# EasyEDA Pro project BLDCv5.eprj, schematic Schematic2_2
Board Name: SPDV4_THT_2; Create Date: 2025-03-22; Page Name: P1; Project Name: BLDCv5; Schematic Name: Schematic2_2; Update Date: 2025-03-22; Company: EasyEDA.com; Drawn: EasyEDA; Page Size: A4; Part Number: JLCPCB-002; Reviewed: EasyEDA; Version: V0.1
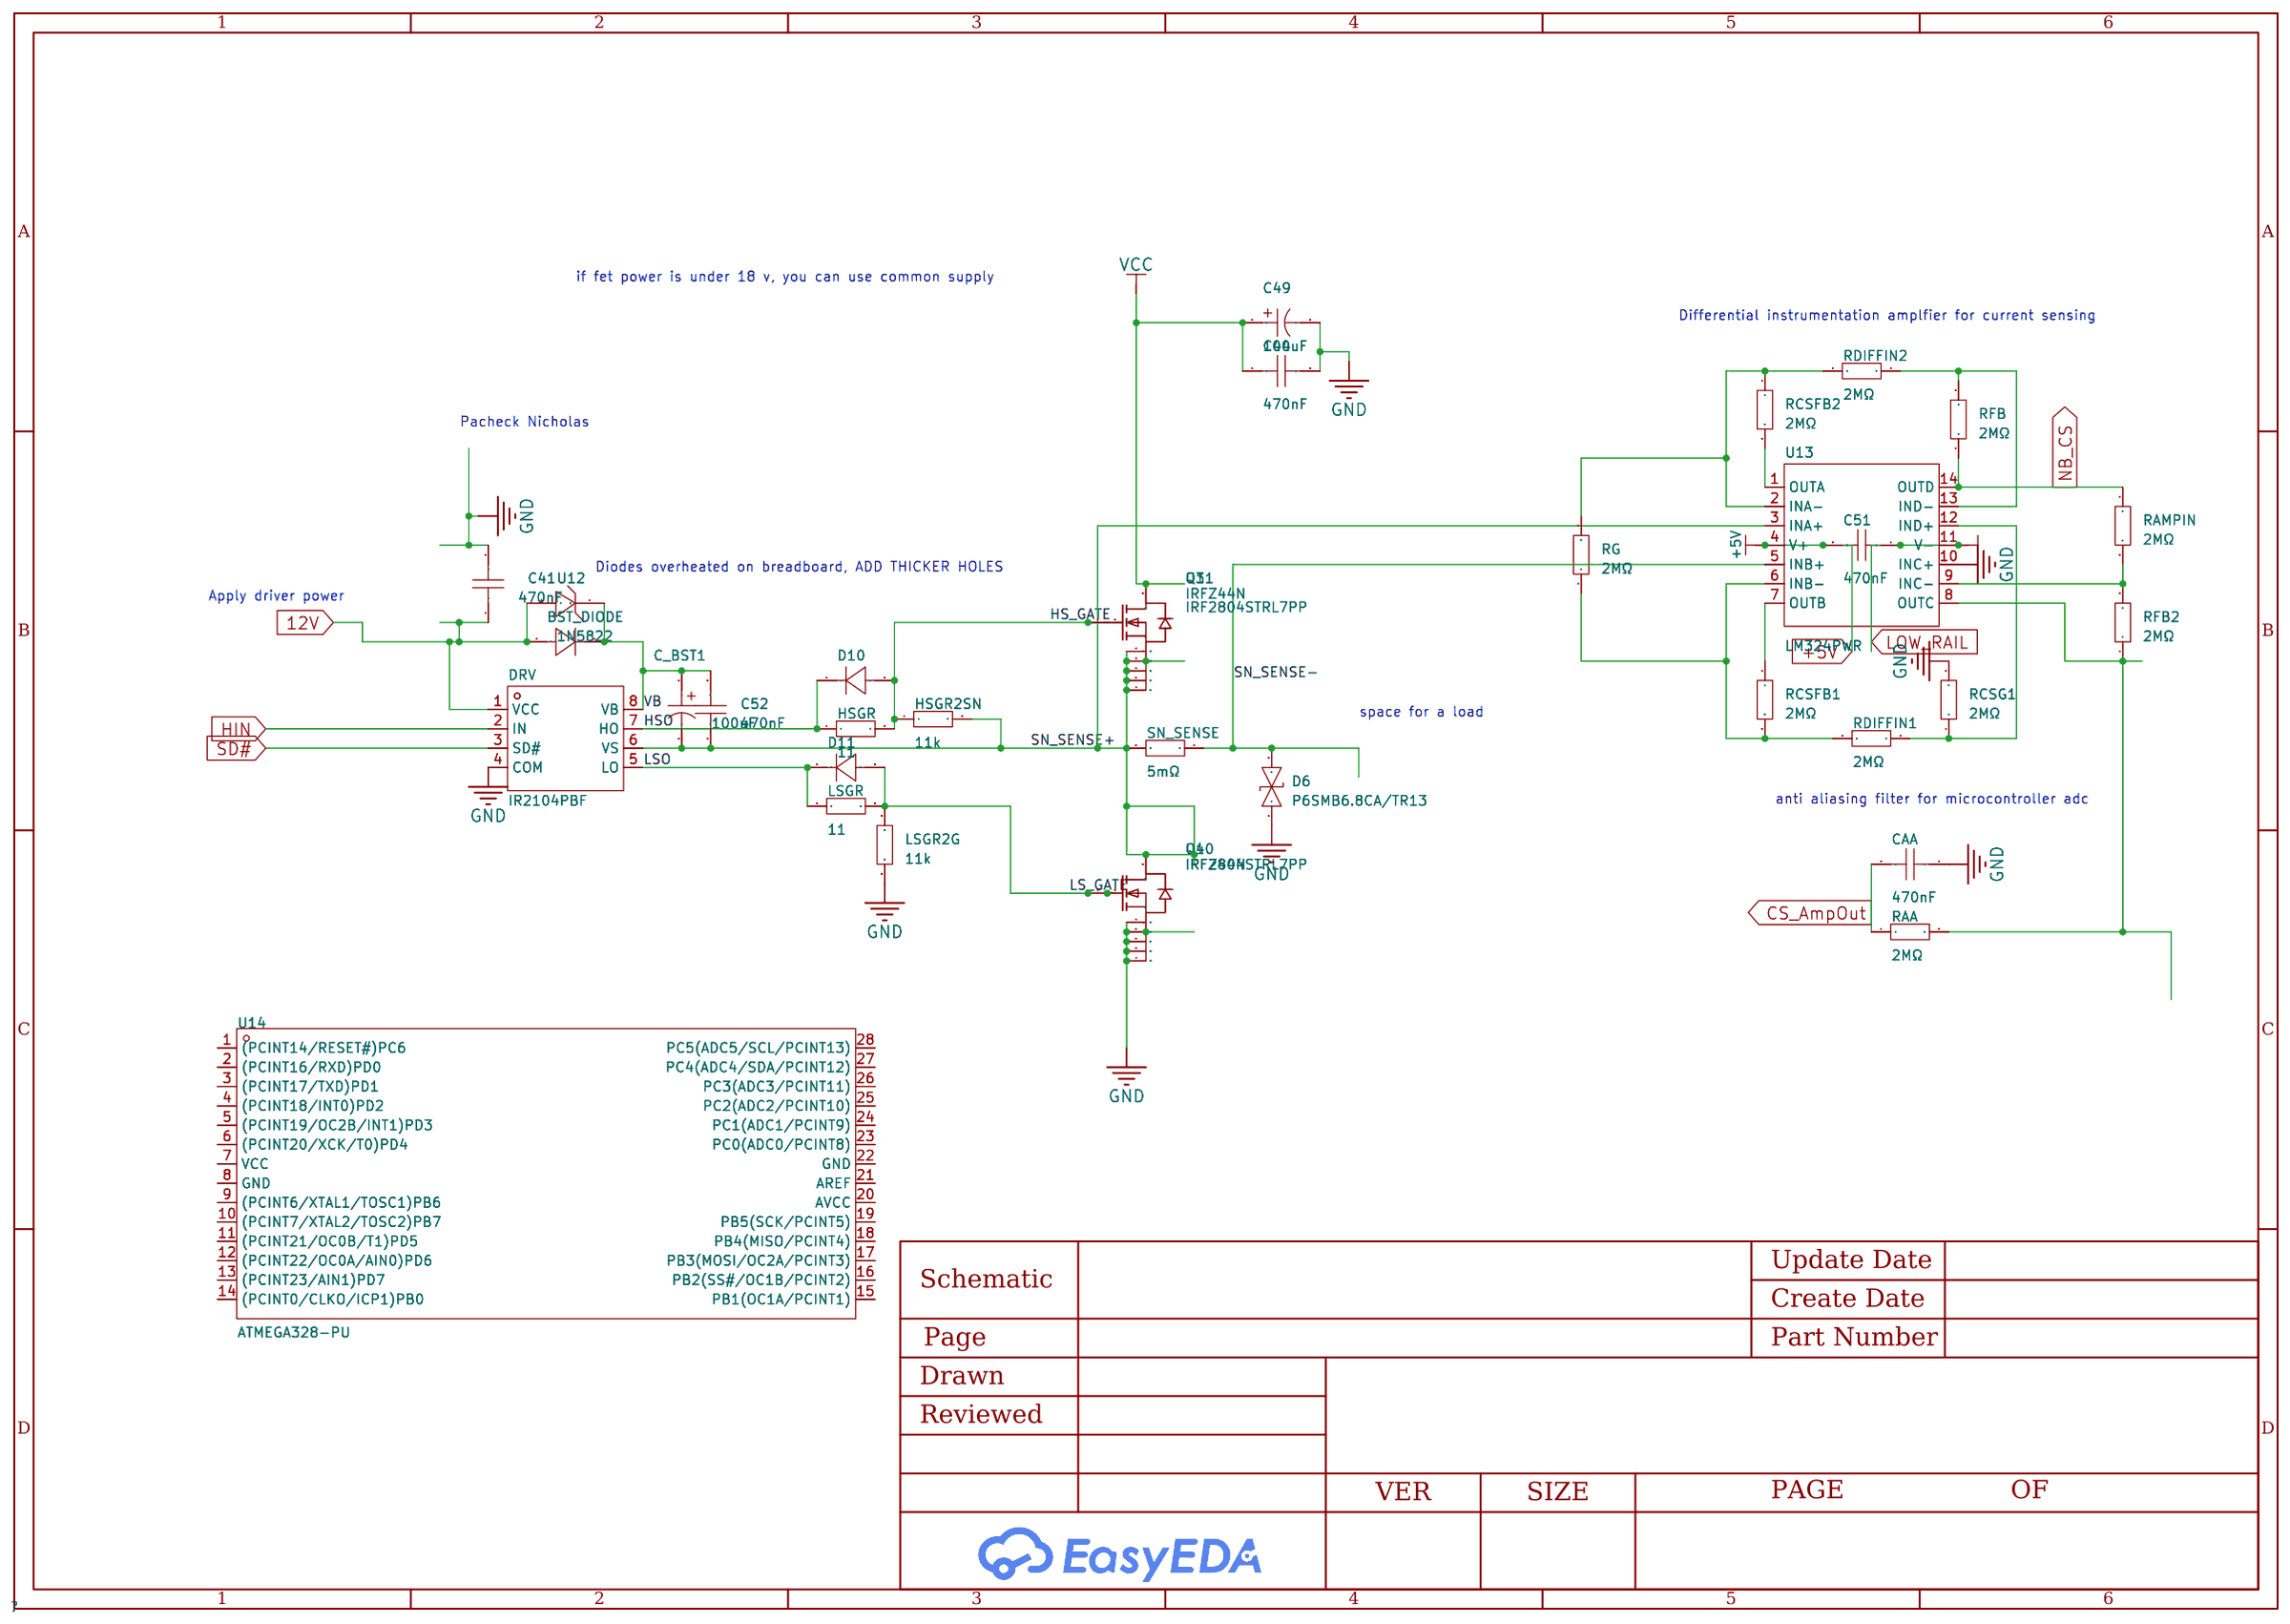
[diagram p5: schematic sheet]

## Parts
BST_DIODE  -  [DO-41_BD2.4-L4.7-P8.70-D0.9-RD]
C41  470nF  [CAP-TH_L7.2-W2.5-P5.00-D0.5]
C44  470nF  [CAP-TH_L7.2-W2.5-P5.00-D0.5]
C49  100uF  [CAP-TH_BD8.0-P3.50-D0.6-FD]
C51  470nF  [CAP-TH_L7.2-W2.5-P5.00-D0.5]
C52  470nF  [CAP-TH_L7.2-W2.5-P5.00-D0.5]
C_BST1  100uF  [CAP-TH_BD8.0-P3.50-D0.6-FD]
CAA  470nF  [CAP-TH_L7.2-W2.5-P5.00-D0.5]
D6  P6SMB6.8CA/TR13  [SMB_L4.6-W3.6-LS5.3-BI]
D10  -  [DO-41_BD2.4-L4.7-P8.70-D0.9-RD]
D11  -  [DO-41_BD2.4-L4.7-P8.70-D0.9-RD]
DRV  IR2104PBF  [DIP-8_L9.9-W6.6-P2.54-LS7.62-BL]
HSGR  11  [RES-TH_BD3.3-L9.0-P13.00-D0.6]
HSGR2SN  11k  [RES-TH_BD3.3-L9.0-P13.00-D0.6]
LSGR  11  [RES-TH_BD3.3-L9.0-P13.00-D0.6]
LSGR2G  11k  [RES-TH_BD3.3-L9.0-P13.00-D0.6]
Q3  IRF2804STRL7PP  [D2PAK-7_L10.6-W9.6-P1.27-LS15.9-BR]
Q4  IRF2804STRL7PP  [D2PAK-7_L10.6-W9.6-P1.27-LS15.9-BR]
RAA  2MΩ  [R0805]
RAMPIN  2MΩ  [R0805]
RCSFB1  2MΩ  [R0805]
RCSFB2  2MΩ  [R0805]
RCSG1  2MΩ  [R0805]
RDIFFIN1  2MΩ  [R0805]
RDIFFIN2  2MΩ  [R0805]
RFB  2MΩ  [R0805]
RFB2  2MΩ  [R0805]
RG  2MΩ  [R0805]
SN_SENSE  5mΩ  [R2512]
U10  IRFZ44N  [TO-220-3_L9.9-W4.5-P2.54-L]
U11  IRFZ44N  [TO-220-3_L9.9-W4.5-P2.54-L]
U12  1N5822  [SMA_L4.3-W2.6-LS5.1-RD]
U13  LM324PWR  [TSSOP-14_L5.0-W4.4-P0.65-LS6.4-BL]
U14  ATMEGA328-PU  [DIP-28_L35.0-W6.5-P2.54-LS7.6-BL]

## Library data of the parts
BST_DIODE D10 D11 = 1N4007: Supplier Footprint: DO-41
C41 C44 C51 C52 CAA = C241J474J20C000: Capacitance:470nF Tolerance:±5% Tolerance:±5% Voltage Rated: Dielectric Material:Metallized Polyester Film Capacitor Operating Temperature:-55℃~+125℃ Operating Temperature:-55℃~+125℃; LCSC Part Name: 470nF ±5% 63V; Supplier Part: C5121927; Manufacturer: faratronic(厦门法拉); Supplier Footprint: 插件,P=5mm; JLCPCB Part Class: Extended Part; Datasheet: https://atta.szlcsc.com/upload/public/pdf/source/20220309/53E9D6585E584592026F1B9FCED89B93.pdf; Supplier: LCSC; Tolerance: ±5%; Dielectric Material: Metallized Polyester Film Capacitor; Operating Temperature: -55℃~+125℃
C49 C_BST1 = EGT226M2AF12RR: Capacitance: Tolerance:±20% Tolerance:±20% Rated Voltage: Ripple Current:- Equivalent Series Resistance(ESR):- Lead Spacing: φD:- L:- Lifetime @ Temp:7000hrs@105℃ Operating Temperature:-45℃~+105℃ Operating Temperature:-45℃~+105℃; LCSC Part Name: 22uF ±20% 100V; Supplier Part: C840214; Manufacturer: MAN YUE(万裕科技); Supplier Footprint: 插件; JLCPCB Part Class: Extended Part; Datasheet: https://atta.szlcsc.com/upload/public/pdf/source/20181204/C235371_127DC39C6F805AD99E748A9DC446523D.pdf; Supplier: LCSC; Tolerance: ±20%; Lifetime @ Temp: 7000hrs@105℃; Operating Temperature: -45℃~+105℃
D6 = P6SMB6.8CA/TR13: Reverse Stand-Off Voltage (Vrwm):5.8V Maximum Clamping Voltage:10.5V Peak Pulse Current (Ipp)@10/1000us:58.1A Peak Pulse Power Dissipation (Ppp)@10/1000us:600W Breakdown Voltage:6.45V Type:TVS; Supplier Part: C78395; Manufacturer: Brightking(君耀电子); Supplier Footprint: SMB(DO-214AA); JLCPCB Part Class: Basic Part; Datasheet: https://atta.szlcsc.com/upload/public/pdf/source/20160709/1468031879762.pdf; Supplier: LCSC; Reverse Stand-Off Voltage (Vrwm): 5.8V; Maximum Clamping Voltage: 10.5V; Peak Pulse Current (Ipp)@10/1000us: 58.1A; Peak Pulse Power Dissipation (Ppp)@10/1000us: 600W; Breakdown Voltage: 6.45V; Type: TVS
DRV = IR2104PBF: Driven Configuration:Half Bridge Load Type:MOSFET；IGBT Number of Drivers:2 Peak Output Current(sink):360mA Peak Output Current(source):210mA Supply Voltage:10V~20V Supply Voltage:10V~20V Rise Time:100ns Fall Time:50ns Operating Temperature:-40℃~+150℃@(Tj); LCSC Part Name: IR2104PBF 停产; Supplier Part: C2959; Manufacturer: Infineon(英飞凌); Supplier Footprint: PDIP-8; JLCPCB Part Class: Extended Part; Datasheet: https://atta.szlcsc.com/upload/public/pdf/source/20140906/1457707236579.pdf; Supplier: LCSC; Driven Configuration: Half Bridge; Load Type: MOSFET；IGBT; Number of Drivers: 2; Peak Output Current(sink): 360mA; Peak Output Current(source): 210mA; Supply Voltage: 10V~20V; Rise Time: 100ns; Fall Time: 50ns; Operating Temperature: -40℃~+150℃@(Tj)
HSGR HSGR2SN LSGR LSGR2G = Res_AXIAL-1/2W: Supplier Footprint: Through
Q3 Q4 = IRF2804STRL7PP: Supplier Part: C459950; Manufacturer: Infineon(英飞凌); Supplier Footprint: TO-252-3; JLCPCB Part Class: Extended Part; Datasheet: https://atta.szlcsc.com/upload/public/pdf/source/20211220/39CD65D483719D465F1A88FFAD2C5DF5.pdf; Supplier: LCSC
RAA RAMPIN RCSFB1 RCSFB2 RCSG1 RDIFFIN1 RDIFFIN2 RFB RFB2 RG = SCR0805J2M: Type:Thick Film Resistors Resistance:2MΩ Tolerance:±5% Tolerance:±5% Power(Watts): Overload Voltage (Max): Operating Temperature Range:-55℃~+155℃ Operating Temperature Range:-55℃~+155℃; LCSC Part Name: 厚膜电阻 2MΩ ±5% 125mW; Supplier Part: C3017921; Manufacturer: VO(翔胜); Supplier Footprint: 0805; JLCPCB Part Class: Extended Part; Datasheet: https://atta.szlcsc.com/upload/public/pdf/source/20220513/247AF9639BA21CF93567DC289CCC6A22.pdf; Supplier: LCSC; Type: Thick Film Resistors; Tolerance: ±5%; Operating Temperature Range: -55℃~+155℃
SN_SENSE = PA2512FKF7W0R005E: Type:Current Sensing Resistors Resistance: Tolerance:±1% Tolerance:±1% Power(Watts): Temperature Coefficient:±100ppm/℃ Temperature Coefficient:±100ppm/℃; LCSC Part Name: 5mΩ ±1% 2W; Supplier Part: C309526; Manufacturer: YAGEO(国巨); Supplier Footprint: 2512; JLCPCB Part Class: Extended Part; Datasheet: https://atta.szlcsc.com/upload/public/pdf/source/20190227/C375693_219964CC8B3EBD36DBDF701587FA5938.pdf; Supplier: LCSC; Type: Current Sensing Resistors; Tolerance: ±1%; Temperature Coefficient: ±100ppm/℃
U10 U11 = IRFZ44N: Type:1个NChannel Drain Source Voltage (Vdss):60V Continuous Drain Current (Id): Power Dissipation (Pd): Drain Source On Resistance (RDS(on)@Vgs,Id):12mΩ@10V,25A Gate Threshold Voltage (Vgs(th)@Id):3V@250uA Total Gate Charge (Qg@Vgs):31nC@10V Input Capacita; LCSC Part Name: 1个N沟道 耐压:60V 电流:60A; Supplier Part: C7429904; Manufacturer: minos(迈诺斯); Supplier Footprint: TO-220; JLCPCB Part Class: Extended Part; Datasheet: https://atta.szlcsc.com/upload/public/pdf/source/20230807/91A846AFF378822B6B73E3D1D52219D8.pdf; Supplier: LCSC; Type: 1个NChannel; Drain Source Voltage (Vdss): 60V; Drain Source On Resistance (RDS(on)@Vgs,Id): 12mΩ@10V,25A; Gate Threshold Voltage (Vgs(th)@Id): 3V@250uA; Total Gate Charge (Qg@Vgs): 31nC@10V; Input Capacitance (Ciss@Vds): 910pF@25V; Reverse Transfer Capacitance (Crss@Vds): 30pF@25V; Operating Temperature: -55℃~+175℃@(Tj)
U12 = 1N5822_C9900009641: Supplier Part: C9900009641; JLCPCB Part Class: Extended Part; Supplier: LCSC
U13 = LM324PWR: Supplier Part: C7942; Manufacturer: TI(德州仪器); Supplier Footprint: TSSOP-14; JLCPCB Part Class: Extended Part; Datasheet: http://www.ti.com/cn/lit/gpn/lm324; Supplier: LCSC; Number of Circuits: Quad; Gain Bandwidth Product(GBP): 1.2MHz; Current - Input Bias(Ib): 20nA; Slew Rate(SR): 0.5V/us; Output Current: 30mA; Supply Current: 700uA; Operating Temperature: 0℃~+70℃
U14 = ATMEGA328-PU: CPU Core:AVR Program Storage Size:32KB GPIO Ports Number:23 Operating Voltage Range:1.8V~5.5V Operating Voltage Range:1.8V~5.5V CPU Maximum Speed:20MHz Operating Temperature Range:-40℃~+85℃ Operating Temperature Range:-40℃~+85℃ ADC (Bit):10bit Watchdog:有; LCSC Part Name: 基于AVR增强型RISC架构的低功耗CMOS 8位微控制器; Supplier Part: C613508; Manufacturer: MICROCHIP(美国微芯); Supplier Footprint: PDIP-28; JLCPCB Part Class: Extended Part; Datasheet: https://atta.szlcsc.com/upload/public/pdf/source/20210120/C613508_D57921F38AD005C89F39DE8123071AEB.pdf; Supplier: LCSC; CPU Core: AVR; Program Storage Size: 32KB; GPIO Ports Number: 23; Operating Voltage Range: 1.8V~5.5V; CPU Maximum Speed: 20MHz; Operating Temperature Range: -40℃~+85℃; ADC (Bit): 10bit; Watchdog: 有; Low-Voltage Detect: 有; Internal Oscillator: 有

## Nets
12V: BST_DIODE.2(A) C41.1 DRV.1(VCC) U12.2(A)
+5V: C51.2 U13.4(V+)
GND: C41.2 C44.2 C49.2 CAA.1 D6.1 DRV.4(COM) LSGR2G.1 Q4.2(S) Q4.3(S) Q4.5(S) Q4.6(S) Q4.7(S) RCSG1.2 U10.3(S) U13.10(INC+)
VCC: C44.1 C49.1 Q3.4(D) U11.2(D)
CS_AmpOut: CAA.2 RAA.1
HIN: DRV.2(IN)
HS_GATE: D10.2(A) HSGR.2 HSGR2SN.1 Q3.1(G) U11.1(G)
HSO: D10.1(K) DRV.7(HO) HSGR.1
LOW_RAIL: C51.1 U13.11(V-)
LS_GATE: D11.2(A) LSGR.2 LSGR2G.2 Q4.1(G) U10.1(G)
LSO: D11.1(K) DRV.5(LO) LSGR.1
NB_CS: RAMPIN.1 RFB.1 U13.14(OUTD)
SD#: DRV.3(SD#)
SN_SENSE+: C52.1 C_BST1.2 DRV.6(VS) HSGR2SN.2 Q3.2(S) Q3.3(S) Q3.5(S) Q3.6(S) Q3.7(S) Q4.4(D) SN_SENSE.2 U10.2(D) U11.3(S) U13.3(INA+)
SN_SENSE-: D6.2 SN_SENSE.1 U13.5(INB+)
VB: BST_DIODE.1(K) C52.2 C_BST1.1 DRV.8(VB) U12.1(C)
$1N9618: RCSFB2.2 U13.1(OUTA)
$1N9619: RCSFB1.1 U13.7(OUTB)
$1N9620: RCSFB1.2 RDIFFIN1.1 RG.1 U13.6(INB-)
$1N9621: RCSFB2.1 RDIFFIN2.1 RG.2 U13.2(INA-)
$1N9624: RCSG1.1 RDIFFIN1.2 U13.12(IND+)
$1N9626: RDIFFIN2.2 RFB.2 U13.13(IND-)
$1N9695: RAMPIN.2 RFB2.2 U13.9(INC-)
$1N10041: RAA.2 RFB2.1 U13.8(OUTC)

Not connected (* = marked no-connect by the designer): U14 1((PCINT14/RESET#)PC6) 2((PCINT16/RXD)PD0) 3((PCINT17/TXD)PD1) 4((PCINT18/INT0)PD2) 5((PCINT19/OC2B/INT1)PD3) 6((PCINT20/XCK/T0)PD4) 7(VCC) 8(GND) 9((PCINT6/XTAL1/TOSC1)PB6) 10((PCINT7/XTAL2/TOSC2)PB7) 11((PCINT21/OC0B/T1)PD5) 12((PCINT22/OC0A/AIN0)PD6) 13((PCINT23/AIN1)PD7) 14((PCINT0/CLKO/ICP1)PB0) 15(PB1(OC1A/PCINT1)) 16(PB2(SS#/OC1B/PCINT2)) 17(PB3(MOSI/OC2A/PCINT3)) 18(PB4(MISO/PCINT4)) 19(PB5(SCK/PCINT5)) 20(AVCC) 21(AREF) 22(GND) 23(PC0(ADC0/PCINT8)) 24(PC1(ADC1/PCINT9)) 25(PC2(ADC2/PCINT10)) 26(PC3(ADC3/PCINT11)) 27(PC4(ADC4/SDA/PCINT12)) 28(PC5(ADC5/SCL/PCINT13))

## Notes on the sheet
- if fet power is under 18 v, you can use common supply
- Differential instrumentation amplfier for current sensing
- Pacheck Nicholas
- Diodes overheated on breadboard, ADD THICKER HOLES
- Apply driver power
- space for a load
- anti aliasing filter for microcontroller adc
